# EasyEDA Pro project 3SE_24_Power_Rune.eprj, board Armour (continued)
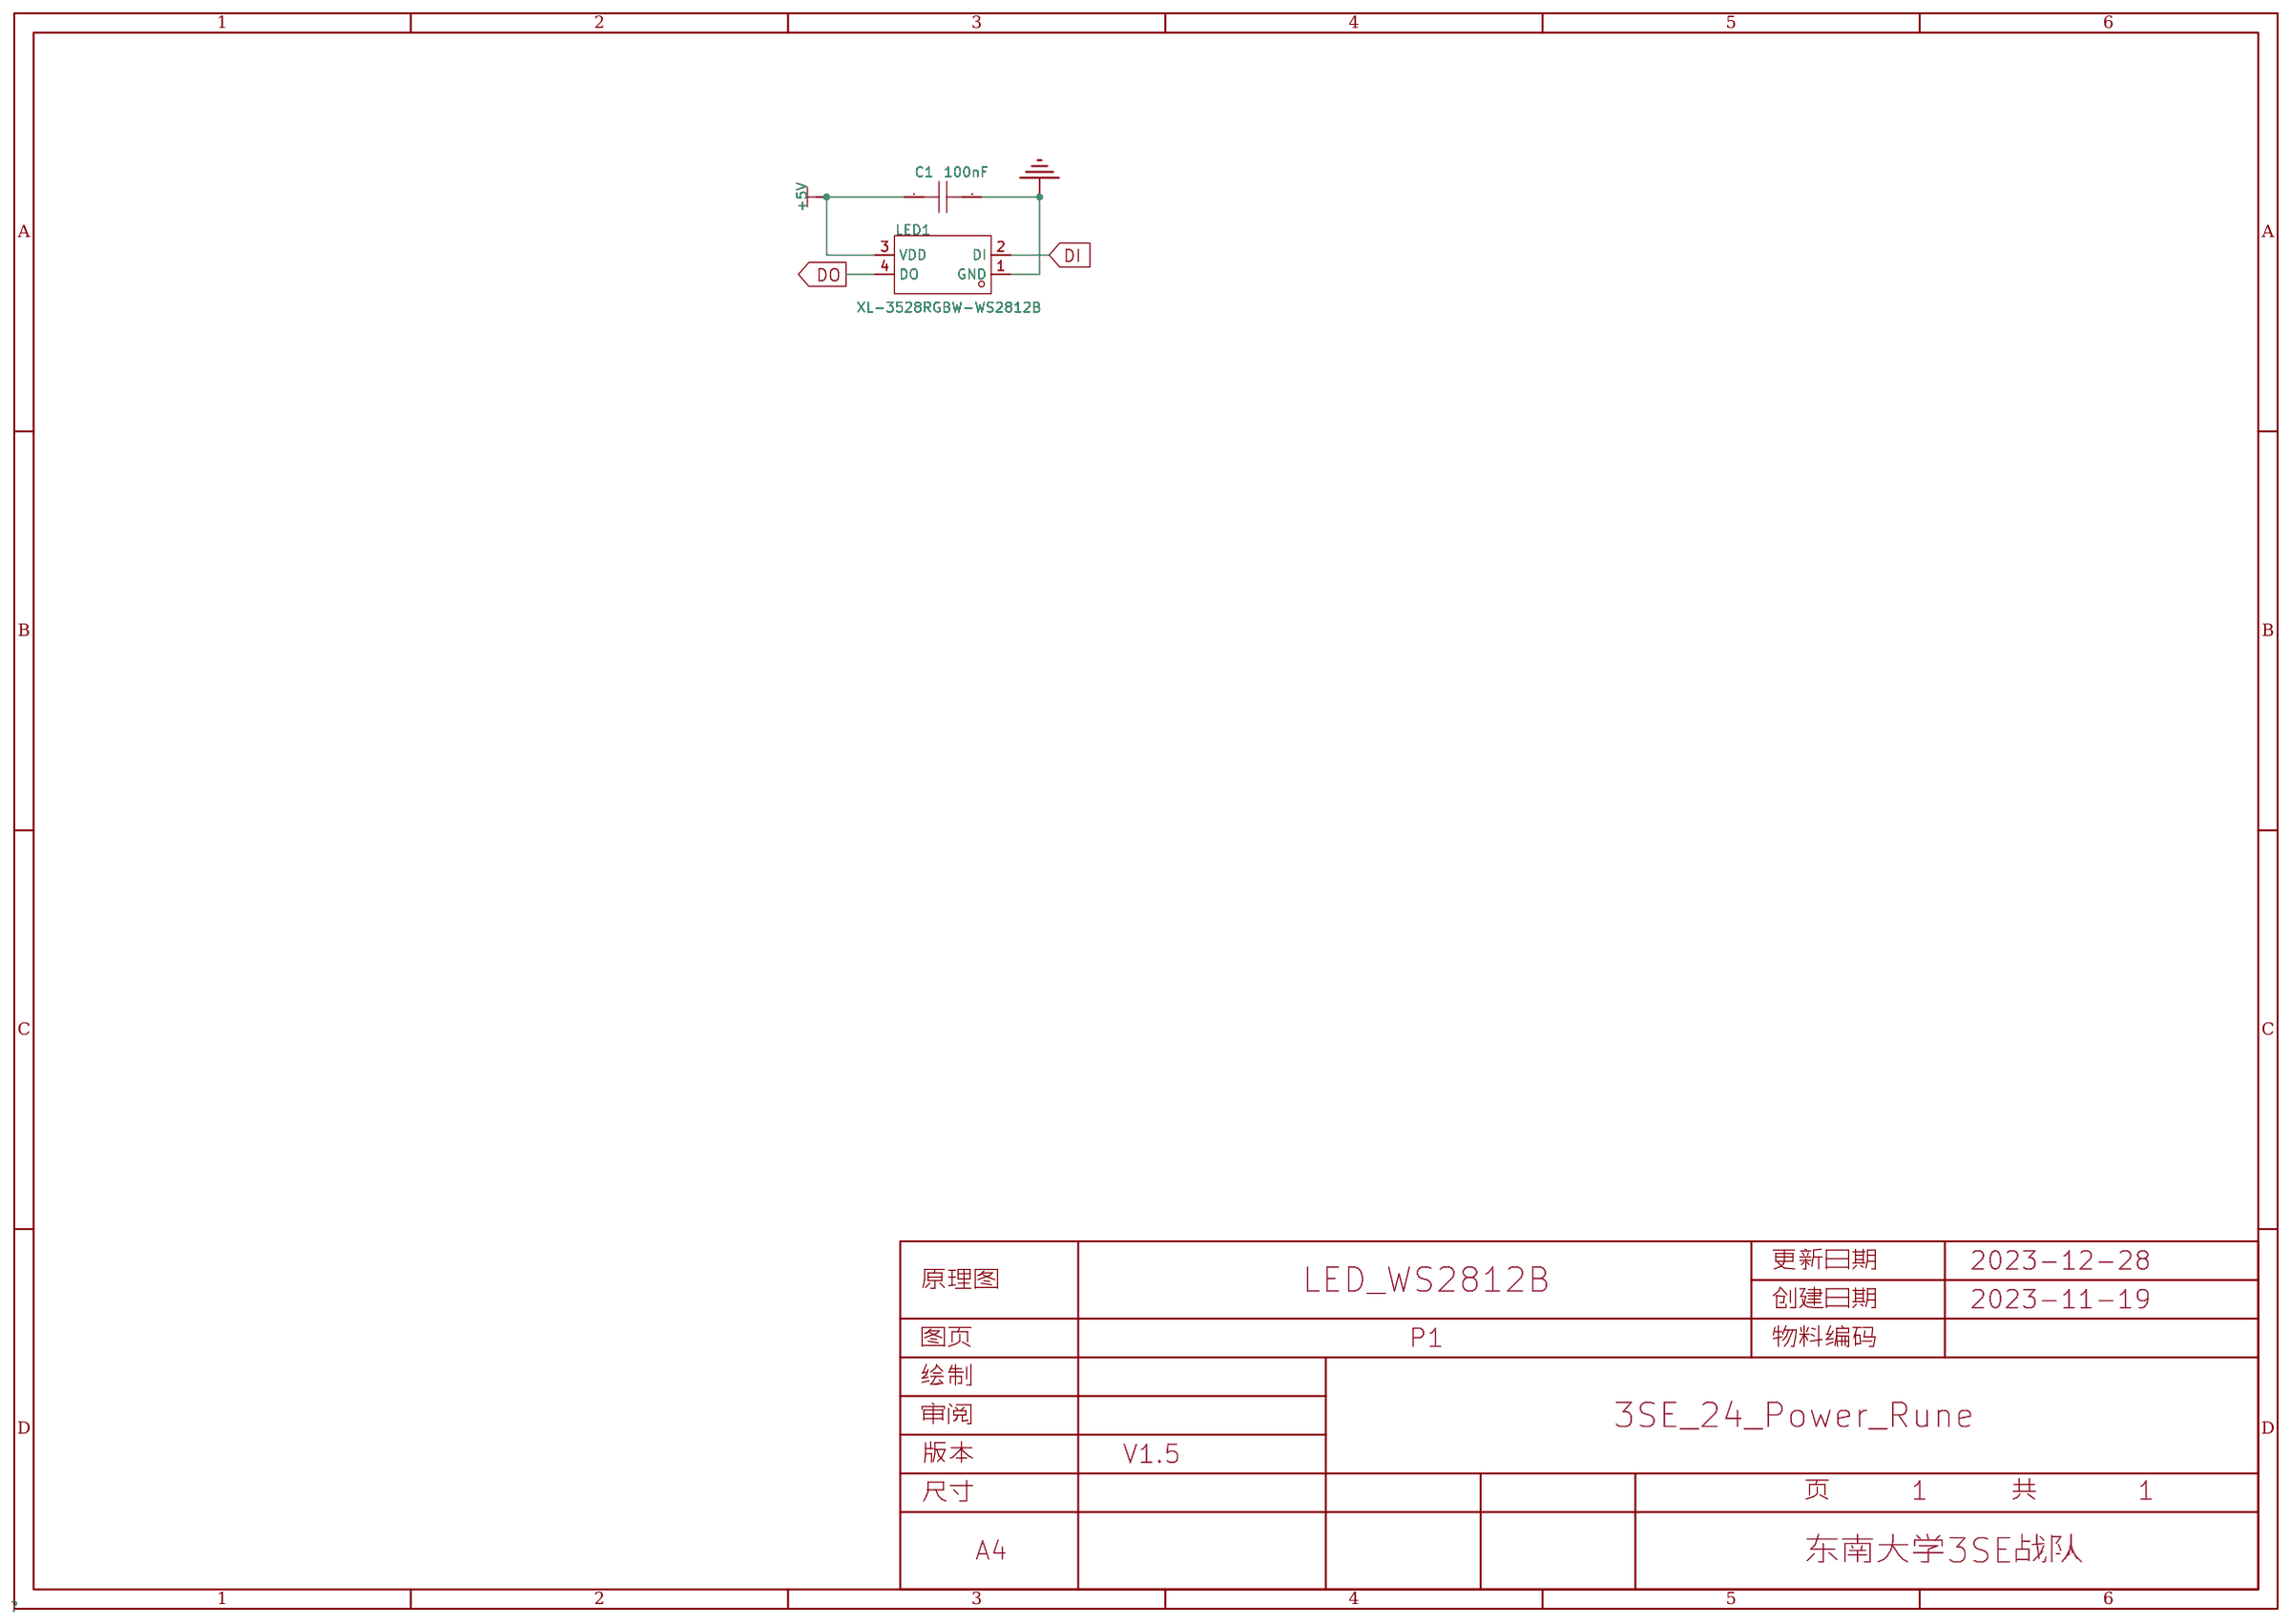
[diagram p0: schematic sheet]
## Routing (per net, layer and track width the routed paths; a pad name or vN(x,y) marks a point on that pad's centre or on a via; arc(x,y) is an arc through that point) (continued)
GND: length 247.9
  Top Layer w0.254: 345.15,207.28 344.64,207.28 343.99,206.62 343.99,205.96 v1(342.83,204.8)
  Bottom Layer w0.254: 103.25,235.91 101.89,237.27 99.96,237.27 ; 303.14,239.36 301.78,238 299.86,238 ; 71.64,154.47 70.28,153.11 68.36,153.11 ; v1(346.24,194.72) 346.37,194.59 346.37,191.62 v1(346.47,191.52) 346.42,191.52 346.39,191.49 ; 226.78,282.02 226.78,280.1 225.42,278.74 ; 206.88,167.92 204.36,170.44 ; 146.42,88.01 146.42,86.08 145.06,84.72 ; v1(326.02,234.98) 326.02,232.62 v1(324.74,231.34) ; 238.26,309.74 238.26,307.81 236.9,306.45 ; 268.25,156.56 270.18,156.56 271.54,155.2 ; 154.1,285.91 155.46,284.55 155.46,282.63 ; 228.88,78.84 228.88,80.77 227.52,82.13 ; v1(342.83,204.8) 343.04,204.59 v1(346.59,204.59) 346.85,204.59 348.61,206.35 348.61,210.12 348.29,210.44 348.29,212.04 USB1.14 348.41,212.44 345.19,212.44 342.22,215.41 342.22,216.42 343.33,217.53 346.85,217.53 v1(348.02,218.69) v1(348.02,223.64) 347.99,223.67 ; 144.72,110.45 146.08,111.81 146.08,113.73 ; 235.28,238.58 232.76,236.06 ; 183.21,191.16 179.65,191.16 ; 164.62,224.55 167.14,222.03 ; 217.4,106.56 217.4,108.48 216.04,109.84 ; 230.77,158.39 228.26,160.91 ; 295.97,145.08 297.89,145.08 299.25,143.72 ; 77.52,235.57 76.16,236.93 74.24,236.93 ; 212.47,215.36 214.06,216.95 214.06,217.36 ; 157.44,175.11 159.95,177.62 ; 50.41,134.68 52.33,134.68 53.69,136.04 ; v1(348.4,235.09) 351.88,235.09 v1(352.19,234.79) ; 290.09,244.95 292.01,244.95 293.37,246.31 ; 293.98,156.9 295.9,156.9 297.26,155.54 ; 164.45,210.35 161.94,212.86 ; 317.81,256.43 319.73,256.43 321.09,257.79 ; 72.19,248.75 74.11,248.75 75.47,247.39 ; 124.19,331.58 125.55,330.22 125.55,328.29 ; 234.47,91.9 235.83,90.54 235.83,88.61 ; 138.74,156.41 136.22,153.89 ; 133.24,82.73 134.6,84.09 134.6,86.02 ; v1(331.97,190.8) v1(334.11,190.8) 336.7,190.8 v1(336.81,190.91) ; 245.95,64.18 247.31,62.82 247.31,60.89 ; v1(281.47,172.31) 281.47,172.69 v1(280.05,174.11) ; 237.92,335.46 237.92,333.54 236.56,332.18 ; 223.59,241.26 221.08,238.75 ; 207.05,182.12 209.56,179.61 ; 46.52,248.41 48.44,248.41 49.81,247.05 ; 321.69,145.42 323.62,145.42 324.98,144.06 ; 143.41,245.76 145.92,243.25 ; 134.94,60.29 134.94,58.37 133.58,57.01 ; 135.67,303.86 137.03,302.5 137.03,300.57 ; 244.8,262.47 242.29,259.96 ; 249.47,139.69 251.99,137.18 ; 272.14,226.52 274.06,226.52 275.43,227.88 ; v1(350.68,193.62) 352.12,195.05 v1(352.12,195.5) ; 96.07,164.59 98,164.59 99.36,165.95 ; 140.72,234.08 143.24,231.56 ; 143.98,310.34 143.98,312.27 142.62,313.63 ; 150.42,153.72 147.91,151.21 ; 226.44,307.75 226.44,305.82 225.08,304.46 ; 78.12,146.16 80.05,146.16 81.41,147.52 ; 126.69,130 129.21,132.51 ; 122.02,252.78 119.51,255.29 ; 228.09,146.71 225.58,149.22
  vias: v1(352.25,226.8) v1(353.3,247.47)
BOOT: length 46.8
  Top Layer w0.254: 349.88,218.45 349.32,218.45 344.15,223.62 344.15,232.1 347.97,235.92 350.44,235.92 350.83,236.3 350.83,243.21 349.8,244.24 336.73,244.24 SW2.1
DIN: length 56.9
  Top Layer w0.254: 339.24,217.17 339.24,216.64 339.71,216.18 340.56,216.18 341.71,215.03 349.72,215.03 350.65,214.1 350.65,199.97 349.76,199.08 349.76,196.27 352.66,193.37 352.66,188.62 351.94,187.9 343.78,187.9 339.85,191.83 339.85,193.94 U4.3
DIN0: length 14.7
  Top Layer w0.254: U4.13 341.15,200.27 339.76,201.67 335.33,201.67 330.65,196.99 LED1.2
DIN1: length 101.3
  Top Layer w0.254: LED259.2 332.14,265.17 327.2,260.23 327.2,237.05 324.9,234.75 324.06,234.75 323.4,234.09 323.4,231.91 320.65,229.16 320.65,198.36 325.6,193.41 330.02,193.41 331.99,195.38 331.99,196.96 336.16,201.12 339.18,201.12 339.88,200.42 U4.14
DIN2: length 68.7
  Top Layer w0.254: U4.15 338.61,198.14 336.94,196.47 334.56,196.47 332.85,194.75 332.85,167.01 350.7,149.16 350.7,146.88 349.25,145.43 348.15,145.43 LED345.2
DIN3: length 185.5
  Top Layer w0.254: U4.12 342.46,199.42 342.46,198.41 340.31,196.25 337.79,196.25 335.43,193.9 335.43,173.05 362.24,146.24 362.24,54.97 349.89,42.62 349.89,34.71 349.95,34.65
DIN4: length 336.8
  Top Layer w0.254: U4.1 337.34,192.2 338.86,190.69 338.86,172.83 364.13,147.56 364.13,50.79 352.55,39.21 352.55,35.46 349.34,32.25 329.43,32.25 323.04,25.86 301.26,25.86 299.44,24.04 286.72,24.04 281.25,18.57 269.37,18.57 265.68,14.88 251.56,14.88 248.15,11.47 237.09,11.47 233.69,8.07 205.1,8.07 CN4.2
DN: length 25.4
  Top Layer w0.254: U3.13 332.02,219.85 330.77,218.6 330.77,214.69 331.89,213.57 337.85,213.57 338.11,213.83 341.14,213.83 342.04,212.93 342.04,206.78 342.49,206.33 D4.6
DP: length 25.2
  Top Layer w0.254: 342.85,212.69 342.6,212.43 342.6,212.18 342.85,211.93 342.85,211.67 342.6,211.42 342.6,211.16 342.85,210.91 342.85,210.66 342.6,210.4 342.6,210.15 342.85,209.89 342.85,209.64 342.6,209.39 342.6,209.13 342.85,208.88 D4.4 ; 342.85,212.69 342.85,213.05 342.67,213.23 342.31,213.23 342.13,213.41 342.13,213.77 341.95,213.95 341.59,213.95 341.3,214.24 341.01,214.24 340.6,214.65 340.51,214.65 340.09,214.24 340,214.24 339.58,214.65 339.49,214.65 339.07,214.24 337.94,214.24 337.69,213.98 337.26,213.98 337.01,214.24 336.75,214.24 336.5,213.98 336.24,213.98 335.99,214.24 335.74,214.24 335.48,213.98 335.23,213.98 334.97,214.24 334.72,214.24 334.47,213.98 334.21,213.98 333.96,214.24 333.7,214.24 333.45,213.98 333.2,213.98 332.94,214.24 332.69,214.24 332.43,213.98 332.11,213.98 331.43,214.67 331.43,215.21 331.18,215.46 331.18,215.72 331.43,215.97 331.43,216.23 331.18,216.48 331.18,216.73 331.43,216.99 331.43,217.24 331.18,217.5 331.18,217.75 331.43,218 331.43,218.23 331.78,218.58 U3.14
KEY1: length 840.2
  Top Layer w0.254: R4.1 353.04,238.05 351.59,239.5 v1(351.59,240.81)
  Bottom Layer w0.254: 311.57,146.87 313.49,146.87 314.85,145.51 314.26,144.91 314.26,140.52 246.1,72.36 239.81,72.36 241.17,71 241.17,69.07 239.31,67.22 237.84,67.22 234.18,63.56 143.24,63.56 136.38,70.42 136.38,68.49 135.02,67.13 130.72,67.13 61.87,135.98 61.87,142.18 60.51,140.81 58.59,140.81 56.81,142.59 56.81,144.49 55.59,145.71 55.59,241.26 59.93,245.6 58.57,246.96 56.64,246.96 57.44,247.76 57.44,252.9 124.66,320.11 131.69,320.11 131.69,322.04 130.33,323.4 132.11,325.18 136.01,325.18 136.89,326.05 231.12,326.05 235.12,322.05 236.48,323.42 236.48,325.34 243.7,325.34 309.62,259.42 309.62,250.3 311.33,250.3 315.31,254.28 332.09,254.28 340.2,246.17 347.6,246.17 351.59,242.18 v1(351.59,240.81)
KEY1_IN: length 4.6
  Top Layer w0.254: U3.39 351.44,233.82 C441.2 351.52,235.26 351.88,235.61 352.91,235.61
KEY2: length 803.2
  Bottom Layer w0.254: 239.71,317.94 239.71,312.3 307.86,244.14 309.96,244.14 311.32,245.5 329.13,245.5 331.78,242.85 331.78,236.64 332.65,235.77 345.49,235.77 350.52,230.74 v1(351.44,230.74) ; 239.71,317.94 238.35,316.58 237.52,317.41 140.89,317.41 137.85,320.45 ; 239.71,317.94 239.71,319.86 ; 137.85,320.45 136.49,321.81 ; 137.85,320.45 137.85,318.52 69.52,250.19 64.05,250.19 ; 64.05,250.19 65.41,248.83 64.75,248.17 64.75,151.54 60.18,146.97 62.1,146.97 63.46,148.33 63.46,147.53 131.79,79.2 131.79,72.61 133.15,73.97 133.15,75.89 133.81,75.24 230.44,75.24 235.01,70.66 235.01,72.59 233.65,73.95 234.82,75.12 239.48,75.12 306.64,142.28 309.38,142.28 308.02,143.64 306.09,143.64 ; 64.05,250.19 62.06,250.19
KEY2_IN: length 5.3
  Top Layer w0.254: R3.1 353.08,229.44 R7.2 351.59,232.23 C442.2 351.21,232.55 U3.38
KEY3: length 657.9
  Top Layer w0.254: 285.19,240.18 285.19,241.31 279.94,246.56
  Bottom Layer w0.254: 285.19,240.18 283.83,238.81 281.91,238.81 281.91,247.24 232.37,296.78 225.85,296.78 225,297.62 225,295.7 223.64,294.34 215.91,302.06 185.74,302.06 181.94,298.26 145.63,298.26 144.82,297.46 143.59,297.46 141.81,295.68 143.17,294.32 143.17,292.39 136.91,292.39 84.36,239.85 84.36,235.48 86.29,235.48 87.65,234.12 83.8,230.28 83.8,154.8 86.31,152.29 88.23,152.29 89.59,153.66 89.59,142.29 131.45,100.44 137.62,100.44 143.21,94.85 146.5,94.85 ; 147.86,98.13 147.86,96.21 146.5,94.85 ; 229.69,96.79 228.33,98.15 228.33,100.08 ; 229.69,96.79 229.69,97.57 251.83,97.57 291.21,136.95 291.21,145.09 285.44,150.86 285.44,153.51 287.14,155.21 287.14,156.99 285.78,158.35 283.85,158.35 ; 229.69,96.79 228.87,96.79 225.04,92.97 148.38,92.97 146.5,94.85
KEY3_IN: length 80
  Top Layer w0.254: v1(285.63,231.56) 285.63,234.11 277.19,242.55 277.19,245.32 R9.2 279.75,247.88 C443.2 ; v1(334.16,231.3) 334.14,231.28 U3.4 332.03,230.94 330.41,230.94
  Bottom Layer w0.254: v1(285.63,231.56) 301.32,231.56 307.51,237.76 326.85,237.76 333.31,231.3 v1(334.16,231.3)
KEY4: length 613.8
  Top Layer w0.254: R10.1 284.5,228.52 280.35,232.66 280.32,232.66
  Bottom Layer w0.254: 91.76,238.71 96.95,238.71 149.04,290.81 149.33,290.81 149.33,292.73 ; 91.76,238.71 93.02,237.46 93.02,161.65 91.18,159.81 89.82,158.45 87.89,158.45 87.89,158.04 93.79,152.15 93.79,146.69 118.62,121.86 120.71,121.86 142.76,99.81 144.63,101.68 144.63,103.61 146.41,103.61 147.31,102.72 148.85,102.72 156.5,95.07 220.22,95.07 223.53,98.38 223.53,100.3 222.17,101.66 223.95,103.44 226,103.44 229.52,106.97 245.68,106.97 260.38,121.67 260.38,131.62 282.09,153.33 280.3,155.12 278.38,155.12 ; 91.76,238.71 89.84,238.71 ; 149.33,292.73 153.09,288.97 226.97,288.97 228.23,290.22 228.23,292.15 231.52,292.15 279.08,244.59 279.08,233.9 280.32,232.66 282.24,232.66 283.61,234.02 ; 149.33,292.73 147.97,294.09
KEY4_IN: length 53.7
  Top Layer w0.254: v1(285.76,229.35) 286,229.1 286,224.07 C444.2 ; R8.1 327.31,229.64 v1(327.93,230.25) 327.98,230.21 332.18,230.21 332.38,230.01
  Bottom Layer w0.254: v1(285.76,229.35) 285.81,229.4 327.07,229.4 v1(327.93,230.25)
KEY5: length 393.5
  Top Layer w0.254: 239.6,253.67 238.91,253.67 237.27,252.04 237.27,250.56 245.63,242.21 R13.1
  Bottom Layer w0.254: 130.6,247.79 128.69,245.88 128.69,140.69 130.58,138.8 131.9,138.8 134.28,141.18 154.22,121.24 214.51,121.24 230.17,136.9 238.08,136.9 243.19,142 243.19,142.39 240.67,144.9 ; 130.6,247.79 130.83,247.57 ; 130.6,247.79 128.31,250.08 129.37,251.14 129.37,251.99 146.07,268.69 219.56,268.69 237.08,251.16 239.6,253.67
KEY5_IN: length 94.3
  Top Layer w0.254: R13.2 248.31,241.33 v1(248.67,241.69) 248.67,239.78 C447.2 ; U3.6 v1(330.91,228.74) 330.38,229.27
  Bottom Layer w0.254: v1(330.91,228.74) 328.69,230.96 327.72,230.96 326.81,230.05 278.37,230.05 277.46,230.96 274.31,230.96 263.58,241.69 v1(248.67,241.69)
KEY6: length 368.2
  Top Layer w0.254: 237.97,244.86 242.82,240.02 R16.1
  Bottom Layer w0.254: 137.12,248.46 137.12,246.68 130.09,239.64 130.09,167.84 141.95,155.98 141.95,154.83 139.75,152.62 138.3,152.62 133.53,147.86 133.53,147.61 ; 137.12,248.46 149.07,260.41 221.11,260.41 236.65,244.86 237.97,244.86 240.48,247.38 ; 137.12,248.46 134.61,250.97 ; 133.53,147.61 134.91,147.61 156.8,125.72 215.48,125.72 233.78,144.02 234.38,144.02 236.89,141.5 ; 133.53,147.61 131.01,145.09
KEY6_IN: length 93.8
  Top Layer w0.254: 327.32,227.94 v1(328.29,227.94) 331.9,227.94 U3.7 ; 244.32,235.6 244.76,236.03 247.44,236.03 C449.2 247.8,236.29 v1(248.82,237.31)
  Bottom Layer w0.254: v1(328.29,227.94) 279.51,227.94 277.25,230.2 255.92,230.2 v1(248.82,237.31)
KEY7: length 265.2
  Top Layer w0.254: 218.38,232.46 219.29,232.46 222.79,228.97 222.79,220.43 R19.1
  Bottom Layer w0.254: 151.8,226.59 149.52,228.87 149.52,229.44 159.25,239.17 211.68,239.17 218.38,232.46 215.87,229.95 ; 151.8,226.59 152.04,226.35 ; 151.8,226.59 151.8,225.42 138.91,212.52 138.91,174.41 150.29,163.03 150.29,161.67 151.94,160.01 153.12,160.01 155.63,162.52 167,151.16 213.89,151.16 218.44,155.71 218.44,159.38 221.97,162.91 221.97,163.6 219.46,166.12
KEY7_IN: length 165.8
  Top Layer w0.254: C451.2 226.46,219.93 v1(226.46,219.16) R19.2 ; U3.18 338.16,217.1 v1(338.16,216.22) R14.1
  Bottom Layer w0.254: v1(226.46,219.16) 226.46,225.53 252.09,251.16 265.39,251.16 278.14,238.41 278.14,234.34 278.39,234.09 278.39,232.85 278.2,232.66 278.2,231.54 279.2,230.54 283.05,230.54 286.3,233.79 301.97,233.79 307.89,239.71 326.97,239.71 335.28,231.4 335.28,219.1 v1(338.16,216.22)
KEY8: length 230.3
  Top Layer w0.254: R21.1 212.7,212.57 216.76,216.63 216.76,223.65
  Bottom Layer w0.254: 213.16,165.23 215.68,162.71 206.96,154 171.35,154 156.52,168.82 154.74,168.82 ; 219.27,226.16 216.76,223.65 215.86,223.65 213.93,225.58 200.79,225.58 196.61,229.76 155.82,229.76 158.33,227.24 158.33,225.53 155.54,222.74 155.54,201.67 148.8,194.93 148.8,174.76 154.74,168.82 ; 154.74,168.82 152.23,166.31
KEY8_IN: length 203.5
  Top Layer w0.254: v1(340.46,218.44) 340.49,218.4 U3.20 ; 339.82,212.32 339.85,212.35 v1(339.85,213.19) ; v1(213.86,182.36) 213.86,180.8 v1(213.85,180.79) ; R21.2 v1(214.2,206.89) 214.2,205.5 C453.2
  Bottom Layer w0.254: v1(213.85,180.79) 214.56,180.08 247.17,180.08 247.98,179.27 321.22,179.27 324.23,182.28 339.14,182.28 347.25,190.39 347.25,196.71 343.79,200.17 343.21,200.17 340.4,202.98 340.4,212.64 v1(339.85,213.19) 339.85,217.83 v1(340.46,218.44) ; v1(213.86,182.36) 213.86,183.31 211.34,185.84 211.34,188.36 214.2,191.22 v1(214.2,206.89)
KEY9: length 18.4
  Top Layer w0.254: R27.1 201.62,185.68 200.76,184.81
  Bottom Layer w0.254: 200.76,184.81 198.25,187.33 ; 170.74,207.66 173.25,205.14
KEY9_IN: length 136.2
  Top Layer w0.254: R27.2 213.23,185.69 v1(213.23,185.74) 213.23,187.4 C456.2 ; U3.12 332.35,221.1 R25.1 330.38,221.06 v1(330.38,220.28)
  Bottom Layer w0.254: v1(213.23,185.74) 241.35,213.86 319.02,213.86 325.44,220.28 v1(330.38,220.28)
KEY10: length 10.8
  Top Layer w0.254: R29.1 189.56,187.37 189.56,193.69
  Bottom Layer w0.254: 189.56,193.69 193.12,193.69
KEY10_IN: length 202.2
  Top Layer w0.254: U3.17 336.73,217.25 v1(336.73,216.21) 336.73,215.47 ; v1(187.37,188.06) 187.37,186.8 187.31,186.74 185.72,186.74 C457.2
  Bottom Layer w0.254: v1(187.37,188.06) 190.38,188.06 196.02,193.69 199.45,193.69 211.45,181.69 260.46,181.69 268.07,189.31 342.61,189.31 345.41,192.11 345.41,197.11 339.81,202.71 339.81,211.6 336.73,214.68 336.73,216.23
RST: length 20.8
  Top Layer w0.254: 327.08,231.4 327.42,231.74 329.55,231.74 330.23,232.42 332.87,232.42 333.75,233.3 333.75,235.48 333.28,235.95 331.89,235.95 331.01,236.83 331.01,244.45 SW1.1
RX: length 34.5
  Top Layer w0.254: CN6.1 352.47,247.41 353.37,246.52 v1(353.37,244.05) ; 349.88,230.01 v1(348.5,230.01)
  Bottom Layer w0.127: v1(348.5,230.01) 348.5,227.66 350.02,226.14 352.47,226.14 353.6,227.27 353.6,243.81 v1(353.37,244.05)
TX: length 31.2
  Top Layer w0.254: v1(348.48,231.34) 349.82,231.34 U3.37 ; v1(348.55,248.67) 348.54,248.67 CN6.2
  Bottom Layer w0.127: v1(348.48,231.34) 349.85,229.97 349.85,227.86 350.38,227.33 351.99,227.33 352.71,228.05 352.71,242.36 348.55,246.53 v1(348.55,248.67)
~CS0: length 25.6
  Top Layer w0.254: v1(343.73,201.05) 343.73,199.49 U4.11 ; v1(343.03,216.14) 343.03,216.14 U3.22
  Bottom Layer w0.254: v1(343.73,201.05) 343.93,201.05 350.04,207.16 350.04,212.65 349.16,213.53 345.64,213.53 v1(343.03,216.14)
~CS1: length 26.4
  Top Layer w0.254: U3.23 344.3,216.18 v1(344.3,216.18) ; U4.10 344.96,200.85 v1(344.93,200.89)
  Bottom Layer w0.254: v1(344.3,216.18) 346.42,214.06 349.55,214.06 350.67,212.94 350.67,204 347.37,200.71 345.11,200.71 v1(344.93,200.89)
~CS2: length 28.3
  Top Layer w0.254: U4.9 346.24,199.44 v1(347.31,199.44) ; U3.31 351.25,223.66 v1(351.26,223.66)
  Bottom Layer w0.254: v1(351.26,223.66) 351.26,203.4 v1(347.31,199.44)
~EN_DEMUX: length 10.6
  Top Layer w0.254: U4.6 343.69,191.4 R31.2 343.82,190.53 344.37,189.98 350.62,189.98 SW3.1
$1N25359: length 23.5
  Top Layer w0.254: LED2.2 327.47,215.59 326.75,214.87 326.75,209.73 324.92,207.9 324.92,196.43 325.86,195.49 LED1.4
$1N25361: length 22.6
  Top Layer w0.254: LED2.4 325.18,214.09 323.48,215.78 323.48,228.6 325.95,231.06 325.95,233.26 325.34,233.87 LED3.2
$1N25595: length 20.6
  Top Layer w0.254: LED5.2 300.65,283.73 306.72,277.67 306.72,267.07 307.05,266.74 LED4.4
$1N25596: length 20.5
  Top Layer w0.254: LED5.4 296.82,282.23 296.01,283.05 296.01,291.25 289.51,297.75 LED6.2
$1N25597: length 19.4
  Top Layer w0.254: LED6.4 284.54,296.25 283.58,297.21 283.58,301.69 275.23,310.04 LED7.2
$1N25653: length 21
  Top Layer w0.254: LED8.2 258.61,320.29 264.37,320.29 268.26,316.4 268.26,310.29 270.01,308.54 LED7.4
$1N25862: length 22.3
  Top Layer w0.254: LED10.4 198,331.92 192.77,331.92 188.99,335.7 188.99,338.4 187.9,339.49 LED11.2
$1N25863: length 15.7
  Top Layer w0.254: LED11.4 168.93,337.99 LED12.2
$1N25864: length 16.9
  Top Layer w0.254: LED13.2 151.21,333.78 162.67,333.78 LED12.4
$1N25867: length 16.2
  Top Layer w0.254: LED14.4 104.14,310.04 LED15.2
$1N25868: length 17.5
  Top Layer w0.254: LED15.4 97.5,305.11 90.14,297.75 LED16.2
$1N25872: length 17
  Top Layer w0.254: LED17.4 71.2,275.59 LED18.2
$1N25874: length 16.4
  Top Layer w0.254: LED17.2 74.2,286.96 LED16.4
$1N25878: length 17.4
  Top Layer w0.254: LED10.2 207.14,338.27 212.27,333.13 LED9.4
$1N26013: length 17
  Top Layer w0.254: LED19.4 46.6,216.22 LED20.2
$1N26014: length 19.1
  Top Layer w0.254: LED21.2 46.22,198.46 46.22,209.35 42.97,212.6 42.97,214.09
$1N26015: length 18.8
  Top Layer w0.254: LED22.2 45.97,185.7 41.75,189.92 LED21.4
$1N26019: length 20.9
  Top Layer w0.254: LED25.2 74.44,110.48 74.44,112.64 68.96,118.11 66.97,118.11 LED24.4
$1N26021: length 19.5
  Top Layer w0.254: LED23.2 49.6,168.91 42.97,175.55 42.97,176.89
$1N26023: length 24
  Top Layer w0.254: LED27.2 101.04,84.47 101.04,86.86 99.77,88.12 90.08,88.12 LED26.4
$1N26024: length 28
  Top Layer w0.254: LED27.4 110.87,69.07 114.39,69.07 114.58,69.26 114.58,72.83 115.33,73.58 LED28.2
$1N26025: length 22.3
  Top Layer w0.254: LED25.4 75.12,104.81 80.64,104.81 86.77,98.69 86.77,96.51 LED26.2
$1N26164: length 26.2
  Top Layer w0.254: LED29.4 148.46,56.75 155.01,56.75 158.15,59.89 166.85,59.89 168.65,58.09 LED30.2
$1N26165: length 34.5
  Top Layer w0.254: LED30.4 166.96,52.89 169.07,52.89 176.68,60.5 188.28,60.5 189.56,59.22 189.56,55.57 188.48,54.49 LED31.2
$1N26167: length 32.4
  Top Layer w0.254: LED33.2 223.69,59.34 222.83,58.49 222.83,56.57 221.83,55.57 219.39,55.57 215.81,59.15 202.64,59.15 201.33,57.84 201.33,54.62 201.74,54.2 LED32.4
$1N26171: length 26
  Top Layer w0.254: LED31.4 184.25,51.5 184.52,51.23 202.31,51.23 204.38,53.3 204.38,54.86 205.23,55.7 LED32.2
$1N26173: length 34.8
  Top Layer w0.254: LED35.4 268.03,82.43 267.02,83.44 267.02,86.92 268.04,87.94 282.63,87.94 286.3,91.61 286.3,95.15 287.38,96.22 LED36.2
$1N26174: length 36.6
  Top Layer w0.254: LED36.4 282.94,94.72 281.66,96 281.66,99.33 284.36,102.02 288.19,102.02 296.31,110.15 296.31,112.78 296.99,113.46 300.05,113.46 300.63,112.87 300.63,110.56 LED37.2
$1N26175: length 30.6
  Top Layer w0.254: LED35.2 273.35,83.93 272.43,83.02 272.43,79.62 260.85,68.05 256.43,68.05 255.5,68.98 LED34.4
$1N26315: length 32.4
  Top Layer w0.254: LED40.2 328.89,178.74 328.89,180.46 328.01,181.33 324.74,181.33 320.28,176.87 320.28,159.45 321.12,158.6 LED39.4
$1N26317: length 21.4
  Top Layer w0.254: 311.75,195.49 310.65,195.49 307.48,198.65 307.48,205.04 309.33,206.89 309.33,211.86 310.47,212.99 LED42.2
$1N26318: length 25.7
  Top Layer w0.254: LED43.2 309.42,232.13 307.69,230.4 307.69,225.74 309.19,224.25 314.35,224.25 315.69,222.91 315.69,218.66 313.47,216.43 LED42.4
$1N26319: length 28.8
  Top Layer w0.254: LED44.2 301.51,254.73 302.37,253.87 302.37,252.12 300.41,250.17 300.41,236.62 306.4,230.63 LED43.4
$1N26321: length 37.3
  Top Layer w0.254: LED40.4 325.53,176.06 327.6,174 330.13,174 331.45,175.31 331.45,181.43 315.87,197 LED41.2
$1N26323: length 19.8
  Top Layer w0.254: LED46.2 285.34,278.94 286.5,277.79 286.5,268.01 291.46,263.05 LED45.4
$1N26324: length 19.3
  Top Layer w0.254: LED46.4 281.53,277.44 280.6,278.38 280.6,285.25 274.11,291.74 LED47.2
$1N26325: length 13.2
  Top Layer w0.254: LED44.4 297.19,253.23 296.67,253.75 296.67,263.96 296.07,264.55 295.38,264.55
$1N26327: length 28.6
  Top Layer w0.254: LED37.4 299.43,106.61 301.74,106.61 309.07,113.94 309.07,124.93 309.88,125.74 LED38.2
$1N26463: length 18.6
  Top Layer w0.254: LED48.4 247.3,301.19 241.69,306.8 241.69,308.76 LED49.2
$1N26464: length 23.6
  Top Layer w0.254: LED49.4 243.21,312.44 237.23,312.44 235.75,310.97 233.33,310.97 228.54,315.75 228.54,317.23 227.52,318.25 226.65,318.25
$1N26465: length 16.7
  Top Layer w0.254: 223.65,316.74 219.27,316.74 213.47,322.55 LED51.2
$1N26467: length 17.8
  Top Layer w0.254: LED53.2 177.13,326.99 183.61,326.99 187.7,322.91 LED52.4
$1N26468: length 17.4
  Top Layer w0.254: LED53.4 167.21,318.57 159.29,318.57 157.78,320.09 LED54.2
$1N26471: length 16.1
  Top Layer w0.254: LED52.2 197.36,324.41 200.72,321.05 LED51.4
$1N26473: length 15.2
  Top Layer w0.254: LED55.4 112.05,297.46 LED56.2
$1N26474: length 16.7
  Top Layer w0.254: LED56.4 105.75,292.28 99.03,285.55 LED57.2
$1N26477: length 17.8
  Top Layer w0.254: LED48.2 259.1,302.69 265.98,295.81 265.98,292.96 268.7,290.24 LED47.4
$1N26613: length 16.9
  Top Layer w0.254: LED59.2 74.67,257.13 76.31,258.76 76.31,266.68 80.06,270.43 LED58.4
$1N26614: length 26.5
  Top Layer w0.254: LED59.4 71.67,253.11 74.83,249.96 74.83,247.62 64.71,237.5 64.71,236.06 64.24,235.6 LED60.2
$1N26615: length 18.4
  Top Layer w0.254: 62.54,223.49 62.87,223.49 69.1,229.72 69.1,235.45 67.45,237.1 LED60.4
$1N26617: length 18.3
  Top Layer w0.254: LED62.4 57.06,203.13 61.01,199.19 61.01,189.04 LED63.2
$1N26618: length 18.8
  Top Layer w0.254: LED64.2 63.08,171.02 63.08,176.13 57.06,182.15 LED63.4
$1N26619: length 14.8
  Top Layer w0.254: LED65.2 66.07,163.34 60.43,168.98 59.54,168.98
$1N26621: length 16.3
  Top Layer w0.254: LED62.2 60.06,221.47 LED61.4
$1N26623: length 20.1
  Top Layer w0.254: LED67.2 84.1,125.6 79.98,129.71 77.59,129.71 LED66.4
$1N26624: length 26.6
  Top Layer w0.254: LED67.4 81.1,114.53 90.33,105.3 93.13,105.3 93.96,106.12 93.96,107.84 94.54,108.42 LED68.2
$1N26625: length 30.9
  Top Layer w0.254: LED66.2 74.67,139.81 70.71,143.78 62.51,143.78 59.99,146.29 59.99,152.84 LED65.4
$1N26627: length 16.4
  Top Layer w0.254: LED58.2 85.5,271.93 92.53,278.96 LED57.4
$1N26763: length 32.8
  Top Layer w0.254: 104.91,95.88 103.87,95.88 103.23,96.53 103.23,99.22 104.78,100.77 111.56,100.77 123.5,88.83 LED70.2
$1N26767: length 38.1
  Top Layer w0.254: LED72.4 168.92,68.68 168.1,69.51 168.1,73.76 169.15,74.81 178.18,74.81 187.41,65.58 189.05,65.58 190.11,66.63 190.11,68.59 191.09,69.56 LED73.2
$1N26768: length 35.2
  Top Layer w0.254: LED73.4 188.32,68.06 187.34,69.05 187.34,71.21 189.56,73.43 196.62,73.43 200.23,69.81 200.23,67.24 201.43,66.04 205.99,66.04 207.81,67.86 207.81,70.39 208.85,71.42 LED74.2
$1N26769: length 25.1
  Top Layer w0.254: LED74.4 205.29,69.92 204.42,70.79 204.42,73.48 205.6,74.66 223.59,74.66 LED75.2
$1N26771: length 25.5
  Top Layer w0.254: 153.4,71.77 159.63,65.54 169.54,65.54 172.42,68.42 172.42,69.32 173.29,70.18 LED72.2
$1N26773: length 32.4
  Top Layer w0.254: LED77.2 258.55,93.75 256.24,96.05 248.86,96.05 239.82,87.01 239.82,83.27 241.32,81.77 LED76.4
$1N26774: length 25.7
  Top Layer w0.254: LED77.4 256.34,88.99 263.88,88.99 270.87,95.98 270.87,100.96 272.15,102.23 LED78.2
$1N26775: length 22.4
  Top Layer w0.254: LED76.2 244.31,83.27 243.31,82.27 243.31,80.05 239.28,76.01 227.07,76.01 LED75.4
$1N26777: length 40.3
  Top Layer w0.254: LED68.4 91.64,106.92 90.84,107.72 90.84,110.36 92.81,112.33 97.14,112.33 100.55,108.92 100.55,96.31 103.14,93.72 105.46,93.72 106.37,94.62 106.37,96.51 107.24,97.38 107.91,97.38
$1N26913: length 34.6
  Top Layer w0.254: 286.15,107.73 282.98,107.73 280.9,109.81 LED79.4 ; 286.15,107.73 293.85,115.43 293.85,128.44 294.83,129.42 LED80.2 ; 286.15,107.73 286.77,107.73
$1N26917: length 26
  Top Layer w0.254: LED82.4 309.78,177.74 305.44,182.08 305.44,194.54 302.99,196.99 LED83.2
$1N26918: length 24.8
  Top Layer w0.254: LED84.2 299.28,214.58 300.77,213.1 300.77,207.95 294.27,201.46 294.27,197.24 296.02,195.49 LED83.4
$1N26919: length 28.3
  Top Layer w0.254: LED84.4 294.33,213.08 293.11,214.31 293.11,217.43 296.41,220.72 296.41,231.33 295.59,232.15 293.36,232.15 293.11,231.89 293.11,230.58 292.04,229.5 LED85.2
$1N26921: length 29
  Top Layer w0.254: LED82.2 312.85,179.24 311.81,178.19 311.81,158.99 310.43,157.62 307.82,157.62 306.81,158.63 LED81.4
$1N26923: length 18.2
  Top Layer w0.254: LED87.2 278.75,263.11 279.16,262.71 279.16,253.1 283.04,249.22 283.04,248.51 LED86.4
$1N26924: length 20
  Top Layer w0.254: LED87.4 274.86,261.61 273.73,262.75 273.73,271.87 269.06,276.53 LED88.2
$1N26925: length 38.1
  Top Layer w0.254: LED86.2 286.46,249.06 285.64,248.25 285.64,245.56 287.25,243.95 287.25,227.19 289.28,225.17 293.77,225.17 295.6,227 295.6,230.33 294.93,231 LED85.4
$1N26927: length 35.5
  Top Layer w0.254: LED79.2 284.42,113.91 284.42,115.85 281.81,118.47 275.75,118.47 274.36,117.07 274.36,113.26 266.91,105.81 266.91,102.32 268.5,100.73 LED78.4
$1N27063: length 20
  Top Layer w0.254: LED89.4 240.95,286.5 236.31,291.15 LED90.2
$1N27064: length 30.9
  Top Layer w0.254: LED90.4 239.31,297.86 238.57,298.61 236.11,298.61 230.57,293.06 226.27,293.06 222.21,297.13 222.21,303.63 221.44,304.41 LED91.2
$1N27065: length 15
  Top Layer w0.254: LED92.2 205.79,308.1 210.99,302.9 LED91.4